# EAGLE board Resistor_Resistor (EAGLE 8.3.0), part 1 of 32 (continued)
## Placement (x,y rotation side) (continued)
R550  10K  [0201]  27.79,92.1 0 top
R551  10K  [0201]  27.79,92.71 0 top
R552  10K  [0201]  27.79,93.32 0 top
R553  10K  [0201]  27.79,93.93 0 top
R554  10K  [0201]  27.79,94.54 0 top
R555  10K  [0201]  27.79,95.15 0 top
R556  10K  [0201]  27.79,95.76 0 top
R557  10K  [0201]  27.79,96.37 0 top
R558  10K  [0201]  27.79,96.98 0 top
R559  10K  [0201]  27.79,97.59 0 top
R560  10K  [0201]  27.79,98.2 0 top
R561  10K  [0201]  27.79,98.81 0 top
R562  10K  [0201]  27.79,99.42 0 top
R563  10K  [0201]  27.79,100.03 0 top
R564  10K  [0201]  27.79,100.63 0 top
R565  10K  [0201]  27.79,101.24 0 top
R566  10K  [0201]  27.79,101.85 0 top
R567  10K  [0201]  27.79,102.46 0 top
R568  10K  [0201]  27.79,103.07 0 top
R569  10K  [0201]  27.79,103.68 0 top
R570  10K  [0201]  27.79,104.29 0 top
R571  10K  [0201]  27.79,104.9 0 top
R572  10K  [0201]  27.79,105.51 0 top
R573  10K  [0201]  27.79,106.12 0 top
R574  10K  [0201]  27.79,106.73 0 top
R575  10K  [0201]  27.79,107.34 0 top
R576  10K  [0201]  27.79,107.95 0 top
R577  10K  [0201]  27.79,108.56 0 top
R578  10K  [0201]  27.79,109.17 0 top
R579  10K  [0201]  27.79,109.78 0 top
R580  10K  [0201]  27.79,110.39 0 top
R581  10K  [0201]  27.79,111 0 top
R582  10K  [0201]  27.79,111.61 0 top
R583  10K  [0201]  27.79,112.22 0 top
R584  10K  [0201]  27.79,112.83 0 top
R585  10K  [0201]  27.79,113.44 0 top
R586  10K  [0201]  27.79,114.05 0 top
R587  10K  [0201]  27.79,114.66 0 top
R588  10K  [0201]  27.79,115.27 0 top
R589  10K  [0201]  27.79,115.87 0 top
R590  10K  [0201]  27.79,116.48 0 top
R591  10K  [0201]  27.79,117.09 0 top
R592  10K  [0201]  27.79,117.7 0 top
R593  10K  [0201]  27.79,118.31 0 top
R594  10K  [0201]  27.79,118.92 0 top
R595  10K  [0201]  27.79,119.53 0 top
R596  10K  [0201]  27.79,120.14 0 top
R597  10K  [0201]  27.79,120.75 0 top
R598  10K  [0201]  27.79,121.36 0 top
R599  10K  [0201]  27.79,121.97 0 top
R600  10K  [0201]  27.79,122.58 0 top
R601  10K  [0201]  29.01,1.27 0 top
R602  10K  [0201]  29.01,1.88 0 top
R603  10K  [0201]  29.01,2.49 0 top
R604  10K  [0201]  29.01,3.1 0 top
R605  10K  [0201]  29.01,3.71 0 top
R606  10K  [0201]  29.01,4.32 0 top
R607  10K  [0201]  29.01,4.93 0 top
R608  10K  [0201]  29.01,5.54 0 top
R609  10K  [0201]  29.01,6.15 0 top
R610  10K  [0201]  29.01,6.76 0 top
R611  10K  [0201]  29.01,7.37 0 top
R612  10K  [0201]  29.01,7.98 0 top
R613  10K  [0201]  29.01,8.59 0 top
R614  10K  [0201]  29.01,9.19 0 top
R615  10K  [0201]  29.01,9.8 0 top
R616  10K  [0201]  29.01,10.41 0 top
R617  10K  [0201]  29.01,11.02 0 top
R618  10K  [0201]  29.01,11.63 0 top
R619  10K  [0201]  29.01,12.24 0 top
R620  10K  [0201]  29.01,12.85 0 top
R621  10K  [0201]  29.01,13.46 0 top
R622  10K  [0201]  29.01,14.07 0 top
R623  10K  [0201]  29.01,14.68 0 top
R624  10K  [0201]  29.01,15.29 0 top
R625  10K  [0201]  29.01,15.9 0 top
R626  10K  [0201]  29.01,16.51 0 top
R627  10K  [0201]  29.01,17.12 0 top
R628  10K  [0201]  29.01,17.73 0 top
R629  10K  [0201]  29.01,18.34 0 top
R630  10K  [0201]  29.01,18.95 0 top
R631  10K  [0201]  29.01,19.56 0 top
R632  10K  [0201]  29.01,20.17 0 top
R633  10K  [0201]  29.01,20.78 0 top
R634  10K  [0201]  29.01,21.39 0 top
R635  10K  [0201]  29.01,22 0 top
R636  10K  [0201]  29.01,22.61 0 top
R637  10K  [0201]  29.01,23.22 0 top
R638  10K  [0201]  29.01,23.83 0 top
R639  10K  [0201]  29.01,24.43 0 top
R640  10K  [0201]  29.01,25.04 0 top
R641  10K  [0201]  29.01,25.65 0 top
R642  10K  [0201]  29.01,26.26 0 top
R643  10K  [0201]  29.01,26.87 0 top
R644  10K  [0201]  29.01,27.48 0 top
R645  10K  [0201]  29.01,28.09 0 top
R646  10K  [0201]  29.01,28.7 0 top
R647  10K  [0201]  29.01,29.31 0 top
R648  10K  [0201]  29.01,29.92 0 top
R649  10K  [0201]  29.01,30.53 0 top
R650  10K  [0201]  29.01,31.14 0 top
R651  10K  [0201]  29.01,31.75 0 top
R652  10K  [0201]  29.01,32.36 0 top
R653  10K  [0201]  29.01,32.97 0 top
R654  10K  [0201]  29.01,33.58 0 top
R655  10K  [0201]  29.01,34.19 0 top
R656  10K  [0201]  29.01,34.8 0 top
R657  10K  [0201]  29.01,35.41 0 top
R658  10K  [0201]  29.01,36.02 0 top
R659  10K  [0201]  29.01,36.63 0 top
R660  10K  [0201]  29.01,37.24 0 top
R661  10K  [0201]  29.01,37.85 0 top
R662  10K  [0201]  29.01,38.46 0 top
R663  10K  [0201]  29.01,39.07 0 top
R664  10K  [0201]  29.01,39.67 0 top
R665  10K  [0201]  29.01,40.28 0 top
R666  10K  [0201]  29.01,40.89 0 top
R667  10K  [0201]  29.01,41.5 0 top
R668  10K  [0201]  29.01,42.11 0 top
R669  10K  [0201]  29.01,42.72 0 top
R670  10K  [0201]  29.01,43.33 0 top
R671  10K  [0201]  29.01,43.94 0 top
R672  10K  [0201]  29.01,44.55 0 top
R673  10K  [0201]  29.01,45.16 0 top
R674  10K  [0201]  29.01,45.77 0 top
R675  10K  [0201]  29.01,46.38 0 top
R676  10K  [0201]  29.01,46.99 0 top
R677  10K  [0201]  29.01,47.6 0 top
R678  10K  [0201]  29.01,48.21 0 top
R679  10K  [0201]  29.01,48.82 0 top
R680  10K  [0201]  29.01,49.43 0 top
R681  10K  [0201]  29.01,50.04 0 top
R682  10K  [0201]  29.01,50.65 0 top
R683  10K  [0201]  29.01,51.26 0 top
R684  10K  [0201]  29.01,51.87 0 top
R685  10K  [0201]  29.01,52.48 0 top
R686  10K  [0201]  29.01,53.09 0 top
R687  10K  [0201]  29.01,53.7 0 top
R688  10K  [0201]  29.01,54.31 0 top
R689  10K  [0201]  29.01,54.91 0 top
R690  10K  [0201]  29.01,55.52 0 top
R691  10K  [0201]  29.01,56.13 0 top
R692  10K  [0201]  29.01,56.74 0 top
R693  10K  [0201]  29.01,57.35 0 top
R694  10K  [0201]  29.01,57.96 0 top
R695  10K  [0201]  29.01,58.57 0 top
R696  10K  [0201]  29.01,59.18 0 top
R697  10K  [0201]  29.01,59.79 0 top
R698  10K  [0201]  29.01,60.4 0 top
R699  10K  [0201]  29.01,61.01 0 top
R700  10K  [0201]  29.01,61.62 0 top
R701  10K  [0201]  29.01,62.23 0 top
R702  10K  [0201]  29.01,62.84 0 top
R703  10K  [0201]  29.01,63.45 0 top
R704  10K  [0201]  29.01,64.06 0 top
R705  10K  [0201]  29.01,64.67 0 top
R706  10K  [0201]  29.01,65.28 0 top
R707  10K  [0201]  29.01,65.89 0 top
R708  10K  [0201]  29.01,66.5 0 top
R709  10K  [0201]  29.01,67.11 0 top
R710  10K  [0201]  29.01,67.72 0 top
R711  10K  [0201]  29.01,68.33 0 top
R712  10K  [0201]  29.01,68.94 0 top
R713  10K  [0201]  29.01,69.55 0 top
R714  10K  [0201]  29.01,70.15 0 top
R715  10K  [0201]  29.01,70.76 0 top
R716  10K  [0201]  29.01,71.37 0 top
R717  10K  [0201]  29.01,71.98 0 top
R718  10K  [0201]  29.01,72.59 0 top
R719  10K  [0201]  29.01,73.2 0 top
R720  10K  [0201]  29.01,73.81 0 top
R721  10K  [0201]  29.01,74.42 0 top
R722  10K  [0201]  29.01,75.03 0 top
R723  10K  [0201]  29.01,75.64 0 top
R724  10K  [0201]  29.01,76.25 0 top
R725  10K  [0201]  29.01,76.86 0 top
R726  10K  [0201]  29.01,77.47 0 top
R727  10K  [0201]  29.01,78.08 0 top
R728  10K  [0201]  29.01,78.69 0 top
R729  10K  [0201]  29.01,79.3 0 top
R730  10K  [0201]  29.01,79.91 0 top
R731  10K  [0201]  29.01,80.52 0 top
R732  10K  [0201]  29.01,81.13 0 top
R733  10K  [0201]  29.01,81.74 0 top
R734  10K  [0201]  29.01,82.35 0 top
R735  10K  [0201]  29.01,82.96 0 top
R736  10K  [0201]  29.01,83.57 0 top
R737  10K  [0201]  29.01,84.18 0 top
R738  10K  [0201]  29.01,84.79 0 top
R739  10K  [0201]  29.01,85.39 0 top
R740  10K  [0201]  29.01,86 0 top
R741  10K  [0201]  29.01,86.61 0 top
R742  10K  [0201]  29.01,87.22 0 top
R743  10K  [0201]  29.01,87.83 0 top
R744  10K  [0201]  29.01,88.44 0 top
R745  10K  [0201]  29.01,89.05 0 top
R746  10K  [0201]  29.01,89.66 0 top
R747  10K  [0201]  29.01,90.27 0 top
R748  10K  [0201]  29.01,90.88 0 top
R749  10K  [0201]  29.01,91.49 0 top
R750  10K  [0201]  29.01,92.1 0 top
R751  10K  [0201]  29.01,92.71 0 top
R752  10K  [0201]  29.01,93.32 0 top
R753  10K  [0201]  29.01,93.93 0 top
R754  10K  [0201]  29.01,94.54 0 top
R755  10K  [0201]  29.01,95.15 0 top
R756  10K  [0201]  29.01,95.76 0 top
R757  10K  [0201]  29.01,96.37 0 top
R758  10K  [0201]  29.01,96.98 0 top
R759  10K  [0201]  29.01,97.59 0 top
R760  10K  [0201]  29.01,98.2 0 top
R761  10K  [0201]  29.01,98.81 0 top
R762  10K  [0201]  29.01,99.42 0 top
R763  10K  [0201]  29.01,100.03 0 top
R764  10K  [0201]  29.01,100.63 0 top
R765  10K  [0201]  29.01,101.24 0 top
R766  10K  [0201]  29.01,101.85 0 top
R767  10K  [0201]  29.01,102.46 0 top
R768  10K  [0201]  29.01,103.07 0 top
R769  10K  [0201]  29.01,103.68 0 top
R770  10K  [0201]  29.01,104.29 0 top
R771  10K  [0201]  29.01,104.9 0 top
R772  10K  [0201]  29.01,105.51 0 top
R773  10K  [0201]  29.01,106.12 0 top
R774  10K  [0201]  29.01,106.73 0 top
R775  10K  [0201]  29.01,107.34 0 top
R776  10K  [0201]  29.01,107.95 0 top
R777  10K  [0201]  29.01,108.56 0 top
R778  10K  [0201]  29.01,109.17 0 top
R779  10K  [0201]  29.01,109.78 0 top
R780  10K  [0201]  29.01,110.39 0 top
R781  10K  [0201]  29.01,111 0 top
R782  10K  [0201]  29.01,111.61 0 top
R783  10K  [0201]  29.01,112.22 0 top
R784  10K  [0201]  29.01,112.83 0 top
R785  10K  [0201]  29.01,113.44 0 top
R786  10K  [0201]  29.01,114.05 0 top
R787  10K  [0201]  29.01,114.66 0 top
R788  10K  [0201]  29.01,115.27 0 top
R789  10K  [0201]  29.01,115.87 0 top
R790  10K  [0201]  29.01,116.48 0 top
R791  10K  [0201]  29.01,117.09 0 top
R792  10K  [0201]  29.01,117.7 0 top
R793  10K  [0201]  29.01,118.31 0 top
R794  10K  [0201]  29.01,118.92 0 top
R795  10K  [0201]  29.01,119.53 0 top
R796  10K  [0201]  29.01,120.14 0 top
R797  10K  [0201]  29.01,120.75 0 top
R798  10K  [0201]  29.01,121.36 0 top
R799  10K  [0201]  29.01,121.97 0 top
R800  10K  [0201]  29.01,122.58 0 top
R801  10K  [0201]  30.23,1.27 0 top
R802  10K  [0201]  30.23,1.88 0 top
R803  10K  [0201]  30.23,2.49 0 top
R804  10K  [0201]  30.23,3.1 0 top
R805  10K  [0201]  30.23,3.71 0 top
R806  10K  [0201]  30.23,4.32 0 top
R807  10K  [0201]  30.23,4.93 0 top
R808  10K  [0201]  30.23,5.54 0 top
R809  10K  [0201]  30.23,6.15 0 top
R810  10K  [0201]  30.23,6.76 0 top
R811  10K  [0201]  30.23,7.37 0 top
R812  10K  [0201]  30.23,7.98 0 top
R813  10K  [0201]  30.23,8.59 0 top
R814  10K  [0201]  30.23,9.19 0 top
R815  10K  [0201]  30.23,9.8 0 top
R816  10K  [0201]  30.23,10.41 0 top
R817  10K  [0201]  30.23,11.02 0 top
R818  10K  [0201]  30.23,11.63 0 top
R819  10K  [0201]  30.23,12.24 0 top
R820  10K  [0201]  30.23,12.85 0 top
R821  10K  [0201]  30.23,13.46 0 top
R822  10K  [0201]  30.23,14.07 0 top
R823  10K  [0201]  30.23,14.68 0 top
R824  10K  [0201]  30.23,15.29 0 top
R825  10K  [0201]  30.23,15.9 0 top
R826  10K  [0201]  30.23,16.51 0 top
R827  10K  [0201]  30.23,17.12 0 top
R828  10K  [0201]  30.23,17.73 0 top
R829  10K  [0201]  30.23,18.34 0 top
R830  10K  [0201]  30.23,18.95 0 top
R831  10K  [0201]  30.23,19.56 0 top
R832  10K  [0201]  30.23,20.17 0 top
R833  10K  [0201]  30.23,20.78 0 top
R834  10K  [0201]  30.23,21.39 0 top
R835  10K  [0201]  30.23,22 0 top
R836  10K  [0201]  30.23,22.61 0 top
R837  10K  [0201]  30.23,23.22 0 top
R838  10K  [0201]  30.23,23.83 0 top
R839  10K  [0201]  30.23,24.43 0 top
R840  10K  [0201]  30.23,25.04 0 top
R841  10K  [0201]  30.23,25.65 0 top
R842  10K  [0201]  30.23,26.26 0 top
R843  10K  [0201]  30.23,26.87 0 top
R844  10K  [0201]  30.23,27.48 0 top
R845  10K  [0201]  30.23,28.09 0 top
R846  10K  [0201]  30.23,28.7 0 top
R847  10K  [0201]  30.23,29.31 0 top
R848  10K  [0201]  30.23,29.92 0 top
R849  10K  [0201]  30.23,30.53 0 top
R850  10K  [0201]  30.23,31.14 0 top
R851  10K  [0201]  30.23,31.75 0 top
R852  10K  [0201]  30.23,32.36 0 top
R853  10K  [0201]  30.23,32.97 0 top
R854  10K  [0201]  30.23,33.58 0 top
R855  10K  [0201]  30.23,34.19 0 top
R856  10K  [0201]  30.23,34.8 0 top
R857  10K  [0201]  30.23,35.41 0 top
R858  10K  [0201]  30.23,36.02 0 top
R859  10K  [0201]  30.23,36.63 0 top
R860  10K  [0201]  30.23,37.24 0 top
R861  10K  [0201]  30.23,37.85 0 top
R862  10K  [0201]  30.23,38.46 0 top
R863  10K  [0201]  30.23,39.07 0 top
R864  10K  [0201]  30.23,39.67 0 top
R865  10K  [0201]  30.23,40.28 0 top
R866  10K  [0201]  30.23,40.89 0 top
R867  10K  [0201]  30.23,41.5 0 top
R868  10K  [0201]  30.23,42.11 0 top
R869  10K  [0201]  30.23,42.72 0 top
R870  10K  [0201]  30.23,43.33 0 top
R871  10K  [0201]  30.23,43.94 0 top
R872  10K  [0201]  30.23,44.55 0 top
R873  10K  [0201]  30.23,45.16 0 top
R874  10K  [0201]  30.23,45.77 0 top
R875  10K  [0201]  30.23,46.38 0 top
R876  10K  [0201]  30.23,46.99 0 top
R877  10K  [0201]  30.23,47.6 0 top
R878  10K  [0201]  30.23,48.21 0 top
R879  10K  [0201]  30.23,48.82 0 top
R880  10K  [0201]  30.23,49.43 0 top
R881  10K  [0201]  30.23,50.04 0 top
R882  10K  [0201]  30.23,50.65 0 top
R883  10K  [0201]  30.23,51.26 0 top
R884  10K  [0201]  30.23,51.87 0 top
R885  10K  [0201]  30.23,52.48 0 top
R886  10K  [0201]  30.23,53.09 0 top
R887  10K  [0201]  30.23,53.7 0 top
R888  10K  [0201]  30.23,54.31 0 top
R889  10K  [0201]  30.23,54.91 0 top
R890  10K  [0201]  30.23,55.52 0 top
R891  10K  [0201]  30.23,56.13 0 top
R892  10K  [0201]  30.23,56.74 0 top
R893  10K  [0201]  30.23,57.35 0 top
R894  10K  [0201]  30.23,57.96 0 top
R895  10K  [0201]  30.23,58.57 0 top
R896  10K  [0201]  30.23,59.18 0 top
R897  10K  [0201]  30.23,59.79 0 top
R898  10K  [0201]  30.23,60.4 0 top
R899  10K  [0201]  30.23,61.01 0 top
R900  10K  [0201]  30.23,61.62 0 top
R901  10K  [0201]  30.23,62.23 0 top
R902  10K  [0201]  30.23,62.84 0 top
R903  10K  [0201]  30.23,63.45 0 top
R904  10K  [0201]  30.23,64.06 0 top
R905  10K  [0201]  30.23,64.67 0 top
R906  10K  [0201]  30.23,65.28 0 top
R907  10K  [0201]  30.23,65.89 0 top
R908  10K  [0201]  30.23,66.5 0 top
R909  10K  [0201]  30.23,67.11 0 top
R910  10K  [0201]  30.23,67.72 0 top
R911  10K  [0201]  30.23,68.33 0 top
R912  10K  [0201]  30.23,68.94 0 top
R913  10K  [0201]  30.23,69.55 0 top
R914  10K  [0201]  30.23,70.15 0 top
R915  10K  [0201]  30.23,70.76 0 top
R916  10K  [0201]  30.23,71.37 0 top
R917  10K  [0201]  30.23,71.98 0 top
R918  10K  [0201]  30.23,72.59 0 top
R919  10K  [0201]  30.23,73.2 0 top
R920  10K  [0201]  30.23,73.81 0 top
R921  10K  [0201]  30.23,74.42 0 top
R922  10K  [0201]  30.23,75.03 0 top
R923  10K  [0201]  30.23,75.64 0 top
R924  10K  [0201]  30.23,76.25 0 top
R925  10K  [0201]  30.23,76.86 0 top
R926  10K  [0201]  30.23,77.47 0 top
R927  10K  [0201]  30.23,78.08 0 top
R928  10K  [0201]  30.23,78.69 0 top
R929  10K  [0201]  30.23,79.3 0 top
R930  10K  [0201]  30.23,79.91 0 top
R931  10K  [0201]  30.23,80.52 0 top
R932  10K  [0201]  30.23,81.13 0 top
R933  10K  [0201]  30.23,81.74 0 top
R934  10K  [0201]  30.23,82.35 0 top
R935  10K  [0201]  30.23,82.96 0 top
R936  10K  [0201]  30.23,83.57 0 top
R937  10K  [0201]  30.23,84.18 0 top
R938  10K  [0201]  30.23,84.79 0 top
R939  10K  [0201]  30.23,85.39 0 top
R940  10K  [0201]  30.23,86 0 top
R941  10K  [0201]  30.23,86.61 0 top
R942  10K  [0201]  30.23,87.22 0 top
R943  10K  [0201]  30.23,87.83 0 top
R944  10K  [0201]  30.23,88.44 0 top
R945  10K  [0201]  30.23,89.05 0 top
R946  10K  [0201]  30.23,89.66 0 top
R947  10K  [0201]  30.23,90.27 0 top
R948  10K  [0201]  30.23,90.88 0 top
R949  10K  [0201]  30.23,91.49 0 top
R950  10K  [0201]  30.23,92.1 0 top
R951  10K  [0201]  30.23,92.71 0 top
R952  10K  [0201]  30.23,93.32 0 top
R953  10K  [0201]  30.23,93.93 0 top
R954  10K  [0201]  30.23,94.54 0 top
R955  10K  [0201]  30.23,95.15 0 top
R956  10K  [0201]  30.23,95.76 0 top
R957  10K  [0201]  30.23,96.37 0 top
R958  10K  [0201]  30.23,96.98 0 top
R959  10K  [0201]  30.23,97.59 0 top
R960  10K  [0201]  30.23,98.2 0 top
R961  10K  [0201]  30.23,98.81 0 top
R962  10K  [0201]  30.23,99.42 0 top
R963  10K  [0201]  30.23,100.03 0 top
R964  10K  [0201]  30.23,100.63 0 top
R965  10K  [0201]  30.23,101.24 0 top
R966  10K  [0201]  30.23,101.85 0 top
R967  10K  [0201]  30.23,102.46 0 top
R968  10K  [0201]  30.23,103.07 0 top
R969  10K  [0201]  30.23,103.68 0 top
R970  10K  [0201]  30.23,104.29 0 top
R971  10K  [0201]  30.23,104.9 0 top
R972  10K  [0201]  30.23,105.51 0 top
R973  10K  [0201]  30.23,106.12 0 top
R974  10K  [0201]  30.23,106.73 0 top
R975  10K  [0201]  30.23,107.34 0 top
R976  10K  [0201]  30.23,107.95 0 top
R977  10K  [0201]  30.23,108.56 0 top
R978  10K  [0201]  30.23,109.17 0 top
R979  10K  [0201]  30.23,109.78 0 top
R980  10K  [0201]  30.23,110.39 0 top
R981  10K  [0201]  30.23,111 0 top
R982  10K  [0201]  30.23,111.61 0 top
R983  10K  [0201]  30.23,112.22 0 top
R984  10K  [0201]  30.23,112.83 0 top
R985  10K  [0201]  30.23,113.44 0 top
R986  10K  [0201]  30.23,114.05 0 top
R987  10K  [0201]  30.23,114.66 0 top
R988  10K  [0201]  30.23,115.27 0 top
R989  10K  [0201]  30.23,115.87 0 top
R990  10K  [0201]  30.23,116.48 0 top
R991  10K  [0201]  30.23,117.09 0 top
R992  10K  [0201]  30.23,117.7 0 top
R993  10K  [0201]  30.23,118.31 0 top
R994  10K  [0201]  30.23,118.92 0 top
R995  10K  [0201]  30.23,119.53 0 top
R996  10K  [0201]  30.23,120.14 0 top
R997  10K  [0201]  30.23,120.75 0 top
R998  10K  [0201]  30.23,121.36 0 top
R999  10K  [0201]  30.23,121.97 0 top
R1000  10K  [0201]  30.23,122.58 0 top
R1001  10K  [0201]  31.45,1.27 0 top
R1002  10K  [0201]  31.45,1.88 0 top
R1003  10K  [0201]  31.45,2.49 0 top
R1004  10K  [0201]  31.45,3.1 0 top
R1005  10K  [0201]  31.45,3.71 0 top
R1006  10K  [0201]  31.45,4.32 0 top
R1007  10K  [0201]  31.45,4.93 0 top
R1008  10K  [0201]  31.45,5.54 0 top
R1009  10K  [0201]  31.45,6.15 0 top
R1010  10K  [0201]  31.45,6.76 0 top
R1011  10K  [0201]  31.45,7.37 0 top
R1012  10K  [0201]  31.45,7.98 0 top
R1013  10K  [0201]  31.45,8.59 0 top
R1014  10K  [0201]  31.45,9.19 0 top
R1015  10K  [0201]  31.45,9.8 0 top
R1016  10K  [0201]  31.45,10.41 0 top
R1017  10K  [0201]  31.45,11.02 0 top
R1018  10K  [0201]  31.45,11.63 0 top
R1019  10K  [0201]  31.45,12.24 0 top
R1020  10K  [0201]  31.45,12.85 0 top
R1021  10K  [0201]  31.45,13.46 0 top
R1022  10K  [0201]  31.45,14.07 0 top
R1023  10K  [0201]  31.45,14.68 0 top
R1024  10K  [0201]  31.45,15.29 0 top
R1025  10K  [0201]  31.45,15.9 0 top
R1026  10K  [0201]  31.45,16.51 0 top
R1027  10K  [0201]  31.45,17.12 0 top
R1028  10K  [0201]  31.45,17.73 0 top
R1029  10K  [0201]  31.45,18.34 0 top
R1030  10K  [0201]  31.45,18.95 0 top
R1031  10K  [0201]  31.45,19.56 0 top
R1032  10K  [0201]  31.45,20.17 0 top
R1033  10K  [0201]  31.45,20.78 0 top
R1034  10K  [0201]  31.45,21.39 0 top
R1035  10K  [0201]  31.45,22 0 top
R1036  10K  [0201]  31.45,22.61 0 top
R1037  10K  [0201]  31.45,23.22 0 top
R1038  10K  [0201]  31.45,23.83 0 top
R1039  10K  [0201]  31.45,24.43 0 top
R1040  10K  [0201]  31.45,25.04 0 top
R1041  10K  [0201]  31.45,25.65 0 top
R1042  10K  [0201]  31.45,26.26 0 top
R1043  10K  [0201]  31.45,26.87 0 top
R1044  10K  [0201]  31.45,27.48 0 top
R1045  10K  [0201]  31.45,28.09 0 top
R1046  10K  [0201]  31.45,28.7 0 top
R1047  10K  [0201]  31.45,29.31 0 top
R1048  10K  [0201]  31.45,29.92 0 top
R1049  10K  [0201]  31.45,30.53 0 top
R1050  10K  [0201]  31.45,31.14 0 top
R1051  10K  [0201]  31.45,31.75 0 top
R1052  10K  [0201]  31.45,32.36 0 top
R1053  10K  [0201]  31.45,32.97 0 top
R1054  10K  [0201]  31.45,33.58 0 top
R1055  10K  [0201]  31.45,34.19 0 top
R1056  10K  [0201]  31.45,34.8 0 top
R1057  10K  [0201]  31.45,35.41 0 top
R1058  10K  [0201]  31.45,36.02 0 top
R1059  10K  [0201]  31.45,36.63 0 top
R1060  10K  [0201]  31.45,37.24 0 top
R1061  10K  [0201]  31.45,37.85 0 top
R1062  10K  [0201]  31.45,38.46 0 top
R1063  10K  [0201]  31.45,39.07 0 top
R1064  10K  [0201]  31.45,39.67 0 top
R1065  10K  [0201]  31.45,40.28 0 top
R1066  10K  [0201]  31.45,40.89 0 top
R1067  10K  [0201]  31.45,41.5 0 top
R1068  10K  [0201]  31.45,42.11 0 top
R1069  10K  [0201]  31.45,42.72 0 top
R1070  10K  [0201]  31.45,43.33 0 top
R1071  10K  [0201]  31.45,43.94 0 top
R1072  10K  [0201]  31.45,44.55 0 top
R1073  10K  [0201]  31.45,45.16 0 top
R1074  10K  [0201]  31.45,45.77 0 top
R1075  10K  [0201]  31.45,46.38 0 top
R1076  10K  [0201]  31.45,46.99 0 top
R1077  10K  [0201]  31.45,47.6 0 top
R1078  10K  [0201]  31.45,48.21 0 top
R1079  10K  [0201]  31.45,48.82 0 top
R1080  10K  [0201]  31.45,49.43 0 top
R1081  10K  [0201]  31.45,50.04 0 top
R1082  10K  [0201]  31.45,50.65 0 top
R1083  10K  [0201]  31.45,51.26 0 top
R1084  10K  [0201]  31.45,51.87 0 top
R1085  10K  [0201]  31.45,52.48 0 top
R1086  10K  [0201]  31.45,53.09 0 top
R1087  10K  [0201]  31.45,53.7 0 top
R1088  10K  [0201]  31.45,54.31 0 top
R1089  10K  [0201]  31.45,54.91 0 top
R1090  10K  [0201]  31.45,55.52 0 top
R1091  10K  [0201]  31.45,56.13 0 top
R1092  10K  [0201]  31.45,56.74 0 top
R1093  10K  [0201]  31.45,57.35 0 top
R1094  10K  [0201]  31.45,57.96 0 top
R1095  10K  [0201]  31.45,58.57 0 top
R1096  10K  [0201]  31.45,59.18 0 top
R1097  10K  [0201]  31.45,59.79 0 top
R1098  10K  [0201]  31.45,60.4 0 top
R1099  10K  [0201]  31.45,61.01 0 top
R1100  10K  [0201]  31.45,61.62 0 top
R1101  10K  [0201]  31.45,62.23 0 top
R1102  10K  [0201]  31.45,62.84 0 top
R1103  10K  [0201]  31.45,63.45 0 top
R1104  10K  [0201]  31.45,64.06 0 top
R1105  10K  [0201]  31.45,64.67 0 top
R1106  10K  [0201]  31.45,65.28 0 top
R1107  10K  [0201]  31.45,65.89 0 top
R1108  10K  [0201]  31.45,66.5 0 top
R1109  10K  [0201]  31.45,67.11 0 top
R1110  10K  [0201]  31.45,67.72 0 top
R1111  10K  [0201]  31.45,68.33 0 top
R1112  10K  [0201]  31.45,68.94 0 top
R1113  10K  [0201]  31.45,69.55 0 top
R1114  10K  [0201]  31.45,70.15 0 top
R1115  10K  [0201]  31.45,70.76 0 top
R1116  10K  [0201]  31.45,71.37 0 top
R1117  10K  [0201]  31.45,71.98 0 top
R1118  10K  [0201]  31.45,72.59 0 top
R1119  10K  [0201]  31.45,73.2 0 top
R1120  10K  [0201]  31.45,73.81 0 top
R1121  10K  [0201]  31.45,74.42 0 top
R1122  10K  [0201]  31.45,75.03 0 top
R1123  10K  [0201]  31.45,75.64 0 top
R1124  10K  [0201]  31.45,76.25 0 top
R1125  10K  [0201]  31.45,76.86 0 top
R1126  10K  [0201]  31.45,77.47 0 top
R1127  10K  [0201]  31.45,78.08 0 top
R1128  10K  [0201]  31.45,78.69 0 top
R1129  10K  [0201]  31.45,79.3 0 top
R1130  10K  [0201]  31.45,79.91 0 top
R1131  10K  [0201]  31.45,80.52 0 top
R1132  10K  [0201]  31.45,81.13 0 top
R1133  10K  [0201]  31.45,81.74 0 top
R1134  10K  [0201]  31.45,82.35 0 top
R1135  10K  [0201]  31.45,82.96 0 top
R1136  10K  [0201]  31.45,83.57 0 top
R1137  10K  [0201]  31.45,84.18 0 top
R1138  10K  [0201]  31.45,84.79 0 top
R1139  10K  [0201]  31.45,85.39 0 top
R1140  10K  [0201]  31.45,86 0 top
R1141  10K  [0201]  31.45,86.61 0 top
R1142  10K  [0201]  31.45,87.22 0 top
R1143  10K  [0201]  31.45,87.83 0 top
R1144  10K  [0201]  31.45,88.44 0 top
R1145  10K  [0201]  31.45,89.05 0 top
R1146  10K  [0201]  31.45,89.66 0 top
R1147  10K  [0201]  31.45,90.27 0 top
R1148  10K  [0201]  31.45,90.88 0 top
R1149  10K  [0201]  31.45,91.49 0 top
R1150  10K  [0201]  31.45,92.1 0 top
R1151  10K  [0201]  31.45,92.71 0 top
R1152  10K  [0201]  31.45,93.32 0 top
R1153  10K  [0201]  31.45,93.93 0 top
R1154  10K  [0201]  31.45,94.54 0 top
R1155  10K  [0201]  31.45,95.15 0 top
R1156  10K  [0201]  31.45,95.76 0 top
R1157  10K  [0201]  31.45,96.37 0 top
R1158  10K  [0201]  31.45,96.98 0 top
R1159  10K  [0201]  31.45,97.59 0 top
R1160  10K  [0201]  31.45,98.2 0 top
R1161  10K  [0201]  31.45,98.81 0 top
R1162  10K  [0201]  31.45,99.42 0 top
R1163  10K  [0201]  31.45,100.03 0 top
R1164  10K  [0201]  31.45,100.63 0 top
R1165  10K  [0201]  31.45,101.24 0 top
R1166  10K  [0201]  31.45,101.85 0 top
R1167  10K  [0201]  31.45,102.46 0 top
R1168  10K  [0201]  31.45,103.07 0 top
R1169  10K  [0201]  31.45,103.68 0 top
R1170  10K  [0201]  31.45,104.29 0 top
R1171  10K  [0201]  31.45,104.9 0 top
R1172  10K  [0201]  31.45,105.51 0 top
R1173  10K  [0201]  31.45,106.12 0 top
R1174  10K  [0201]  31.45,106.73 0 top
R1175  10K  [0201]  31.45,107.34 0 top
R1176  10K  [0201]  31.45,107.95 0 top
R1177  10K  [0201]  31.45,108.56 0 top
R1178  10K  [0201]  31.45,109.17 0 top
R1179  10K  [0201]  31.45,109.78 0 top
R1180  10K  [0201]  31.45,110.39 0 top
R1181  10K  [0201]  31.45,111 0 top
R1182  10K  [0201]  31.45,111.61 0 top
R1183  10K  [0201]  31.45,112.22 0 top
R1184  10K  [0201]  31.45,112.83 0 top
R1185  10K  [0201]  31.45,113.44 0 top
R1186  10K  [0201]  31.45,114.05 0 top
R1187  10K  [0201]  31.45,114.66 0 top
R1188  10K  [0201]  31.45,115.27 0 top
R1189  10K  [0201]  31.45,115.87 0 top
R1190  10K  [0201]  31.45,116.48 0 top
R1191  10K  [0201]  31.45,117.09 0 top
R1192  10K  [0201]  31.45,117.7 0 top
R1193  10K  [0201]  31.45,118.31 0 top
R1194  10K  [0201]  31.45,118.92 0 top
R1195  10K  [0201]  31.45,119.53 0 top
R1196  10K  [0201]  31.45,120.14 0 top
R1197  10K  [0201]  31.45,120.75 0 top
R1198  10K  [0201]  31.45,121.36 0 top
R1199  10K  [0201]  31.45,121.97 0 top
R1200  10K  [0201]  31.45,122.58 0 top
R1201  10K  [0201]  32.66,1.27 0 top
R1202  10K  [0201]  32.66,1.88 0 top
R1203  10K  [0201]  32.66,2.49 0 top
R1204  10K  [0201]  32.66,3.1 0 top
R1205  10K  [0201]  32.66,3.71 0 top
R1206  10K  [0201]  32.66,4.32 0 top
R1207  10K  [0201]  32.66,4.93 0 top
R1208  10K  [0201]  32.66,5.54 0 top
R1209  10K  [0201]  32.66,6.15 0 top
R1210  10K  [0201]  32.66,6.76 0 top
R1211  10K  [0201]  32.66,7.37 0 top
R1212  10K  [0201]  32.66,7.98 0 top
R1213  10K  [0201]  32.66,8.59 0 top
R1214  10K  [0201]  32.66,9.19 0 top
R1215  10K  [0201]  32.66,9.8 0 top
R1216  10K  [0201]  32.66,10.41 0 top
R1217  10K  [0201]  32.66,11.02 0 top
R1218  10K  [0201]  32.66,11.63 0 top
R1219  10K  [0201]  32.66,12.24 0 top
R1220  10K  [0201]  32.66,12.85 0 top
R1221  10K  [0201]  32.66,13.46 0 top
R1222  10K  [0201]  32.66,14.07 0 top
R1223  10K  [0201]  32.66,14.68 0 top
R1224  10K  [0201]  32.66,15.29 0 top
R1225  10K  [0201]  32.66,15.9 0 top
R1226  10K  [0201]  32.66,16.51 0 top
R1227  10K  [0201]  32.66,17.12 0 top
R1228  10K  [0201]  32.66,17.73 0 top
R1229  10K  [0201]  32.66,18.34 0 top
R1230  10K  [0201]  32.66,18.95 0 top
R1231  10K  [0201]  32.66,19.56 0 top
R1232  10K  [0201]  32.66,20.17 0 top
R1233  10K  [0201]  32.66,20.78 0 top
R1234  10K  [0201]  32.66,21.39 0 top
R1235  10K  [0201]  32.66,22 0 top
R1236  10K  [0201]  32.66,22.61 0 top
R1237  10K  [0201]  32.66,23.22 0 top
R1238  10K  [0201]  32.66,23.83 0 top
R1239  10K  [0201]  32.66,24.43 0 top
R1240  10K  [0201]  32.66,25.04 0 top
R1241  10K  [0201]  32.66,25.65 0 top
R1242  10K  [0201]  32.66,26.26 0 top
R1243  10K  [0201]  32.66,26.87 0 top
R1244  10K  [0201]  32.66,27.48 0 top
R1245  10K  [0201]  32.66,28.09 0 top
R1246  10K  [0201]  32.66,28.7 0 top
R1247  10K  [0201]  32.66,29.31 0 top
R1248  10K  [0201]  32.66,29.92 0 top
R1249  10K  [0201]  32.66,30.53 0 top
R1250  10K  [0201]  32.66,31.14 0 top
R1251  10K  [0201]  32.66,31.75 0 top
R1252  10K  [0201]  32.66,32.36 0 top
R1253  10K  [0201]  32.66,32.97 0 top
R1254  10K  [0201]  32.66,33.58 0 top
R1255  10K  [0201]  32.66,34.19 0 top
R1256  10K  [0201]  32.66,34.8 0 top
R1257  10K  [0201]  32.66,35.41 0 top
R1258  10K  [0201]  32.66,36.02 0 top
R1259  10K  [0201]  32.66,36.63 0 top
R1260  10K  [0201]  32.66,37.24 0 top
R1261  10K  [0201]  32.66,37.85 0 top
R1262  10K  [0201]  32.66,38.46 0 top
R1263  10K  [0201]  32.66,39.07 0 top
R1264  10K  [0201]  32.66,39.67 0 top
R1265  10K  [0201]  32.66,40.28 0 top
R1266  10K  [0201]  32.66,40.89 0 top
R1267  10K  [0201]  32.66,41.5 0 top
R1268  10K  [0201]  32.66,42.11 0 top
R1269  10K  [0201]  32.66,42.72 0 top
R1270  10K  [0201]  32.66,43.33 0 top
R1271  10K  [0201]  32.66,43.94 0 top
R1272  10K  [0201]  32.66,44.55 0 top
R1273  10K  [0201]  32.66,45.16 0 top
R1274  10K  [0201]  32.66,45.77 0 top
R1275  10K  [0201]  32.66,46.38 0 top
R1276  10K  [0201]  32.66,46.99 0 top
R1277  10K  [0201]  32.66,47.6 0 top
R1278  10K  [0201]  32.66,48.21 0 top
R1279  10K  [0201]  32.66,48.82 0 top
R1280  10K  [0201]  32.66,49.43 0 top
R1281  10K  [0201]  32.66,50.04 0 top
R1282  10K  [0201]  32.66,50.65 0 top
R1283  10K  [0201]  32.66,51.26 0 top
R1284  10K  [0201]  32.66,51.87 0 top
R1285  10K  [0201]  32.66,52.48 0 top
R1286  10K  [0201]  32.66,53.09 0 top
R1287  10K  [0201]  32.66,53.7 0 top
R1288  10K  [0201]  32.66,54.31 0 top
R1289  10K  [0201]  32.66,54.91 0 top
R1290  10K  [0201]  32.66,55.52 0 top
R1291  10K  [0201]  32.66,56.13 0 top
R1292  10K  [0201]  32.66,56.74 0 top
R1293  10K  [0201]  32.66,57.35 0 top
R1294  10K  [0201]  32.66,57.96 0 top
R1295  10K  [0201]  32.66,58.57 0 top
R1296  10K  [0201]  32.66,59.18 0 top
R1297  10K  [0201]  32.66,59.79 0 top
R1298  10K  [0201]  32.66,60.4 0 top
R1299  10K  [0201]  32.66,61.01 0 top
R1300  10K  [0201]  32.66,61.62 0 top
R1301  10K  [0201]  32.66,62.23 0 top
R1302  10K  [0201]  32.66,62.84 0 top
R1303  10K  [0201]  32.66,63.45 0 top
R1304  10K  [0201]  32.66,64.06 0 top
R1305  10K  [0201]  32.66,64.67 0 top
R1306  10K  [0201]  32.66,65.28 0 top
R1307  10K  [0201]  32.66,65.89 0 top
R1308  10K  [0201]  32.66,66.5 0 top
R1309  10K  [0201]  32.66,67.11 0 top